# EasyEDA Pro project DartBLDC_Crtl(V2).eprj

# Schematic DartBLDC_Crtl

## Sheets
1 MainBoard: Create Date: 2024-02-13; Page Name: MainBoard; Project Name: DartBLDC_Crtl(V2); Schematic Name: DartBLDC_Crtl; Update Date: 2024-03-26; Company: SEU; Drawed: 陈申; Page Size: A3; Version: V1.0
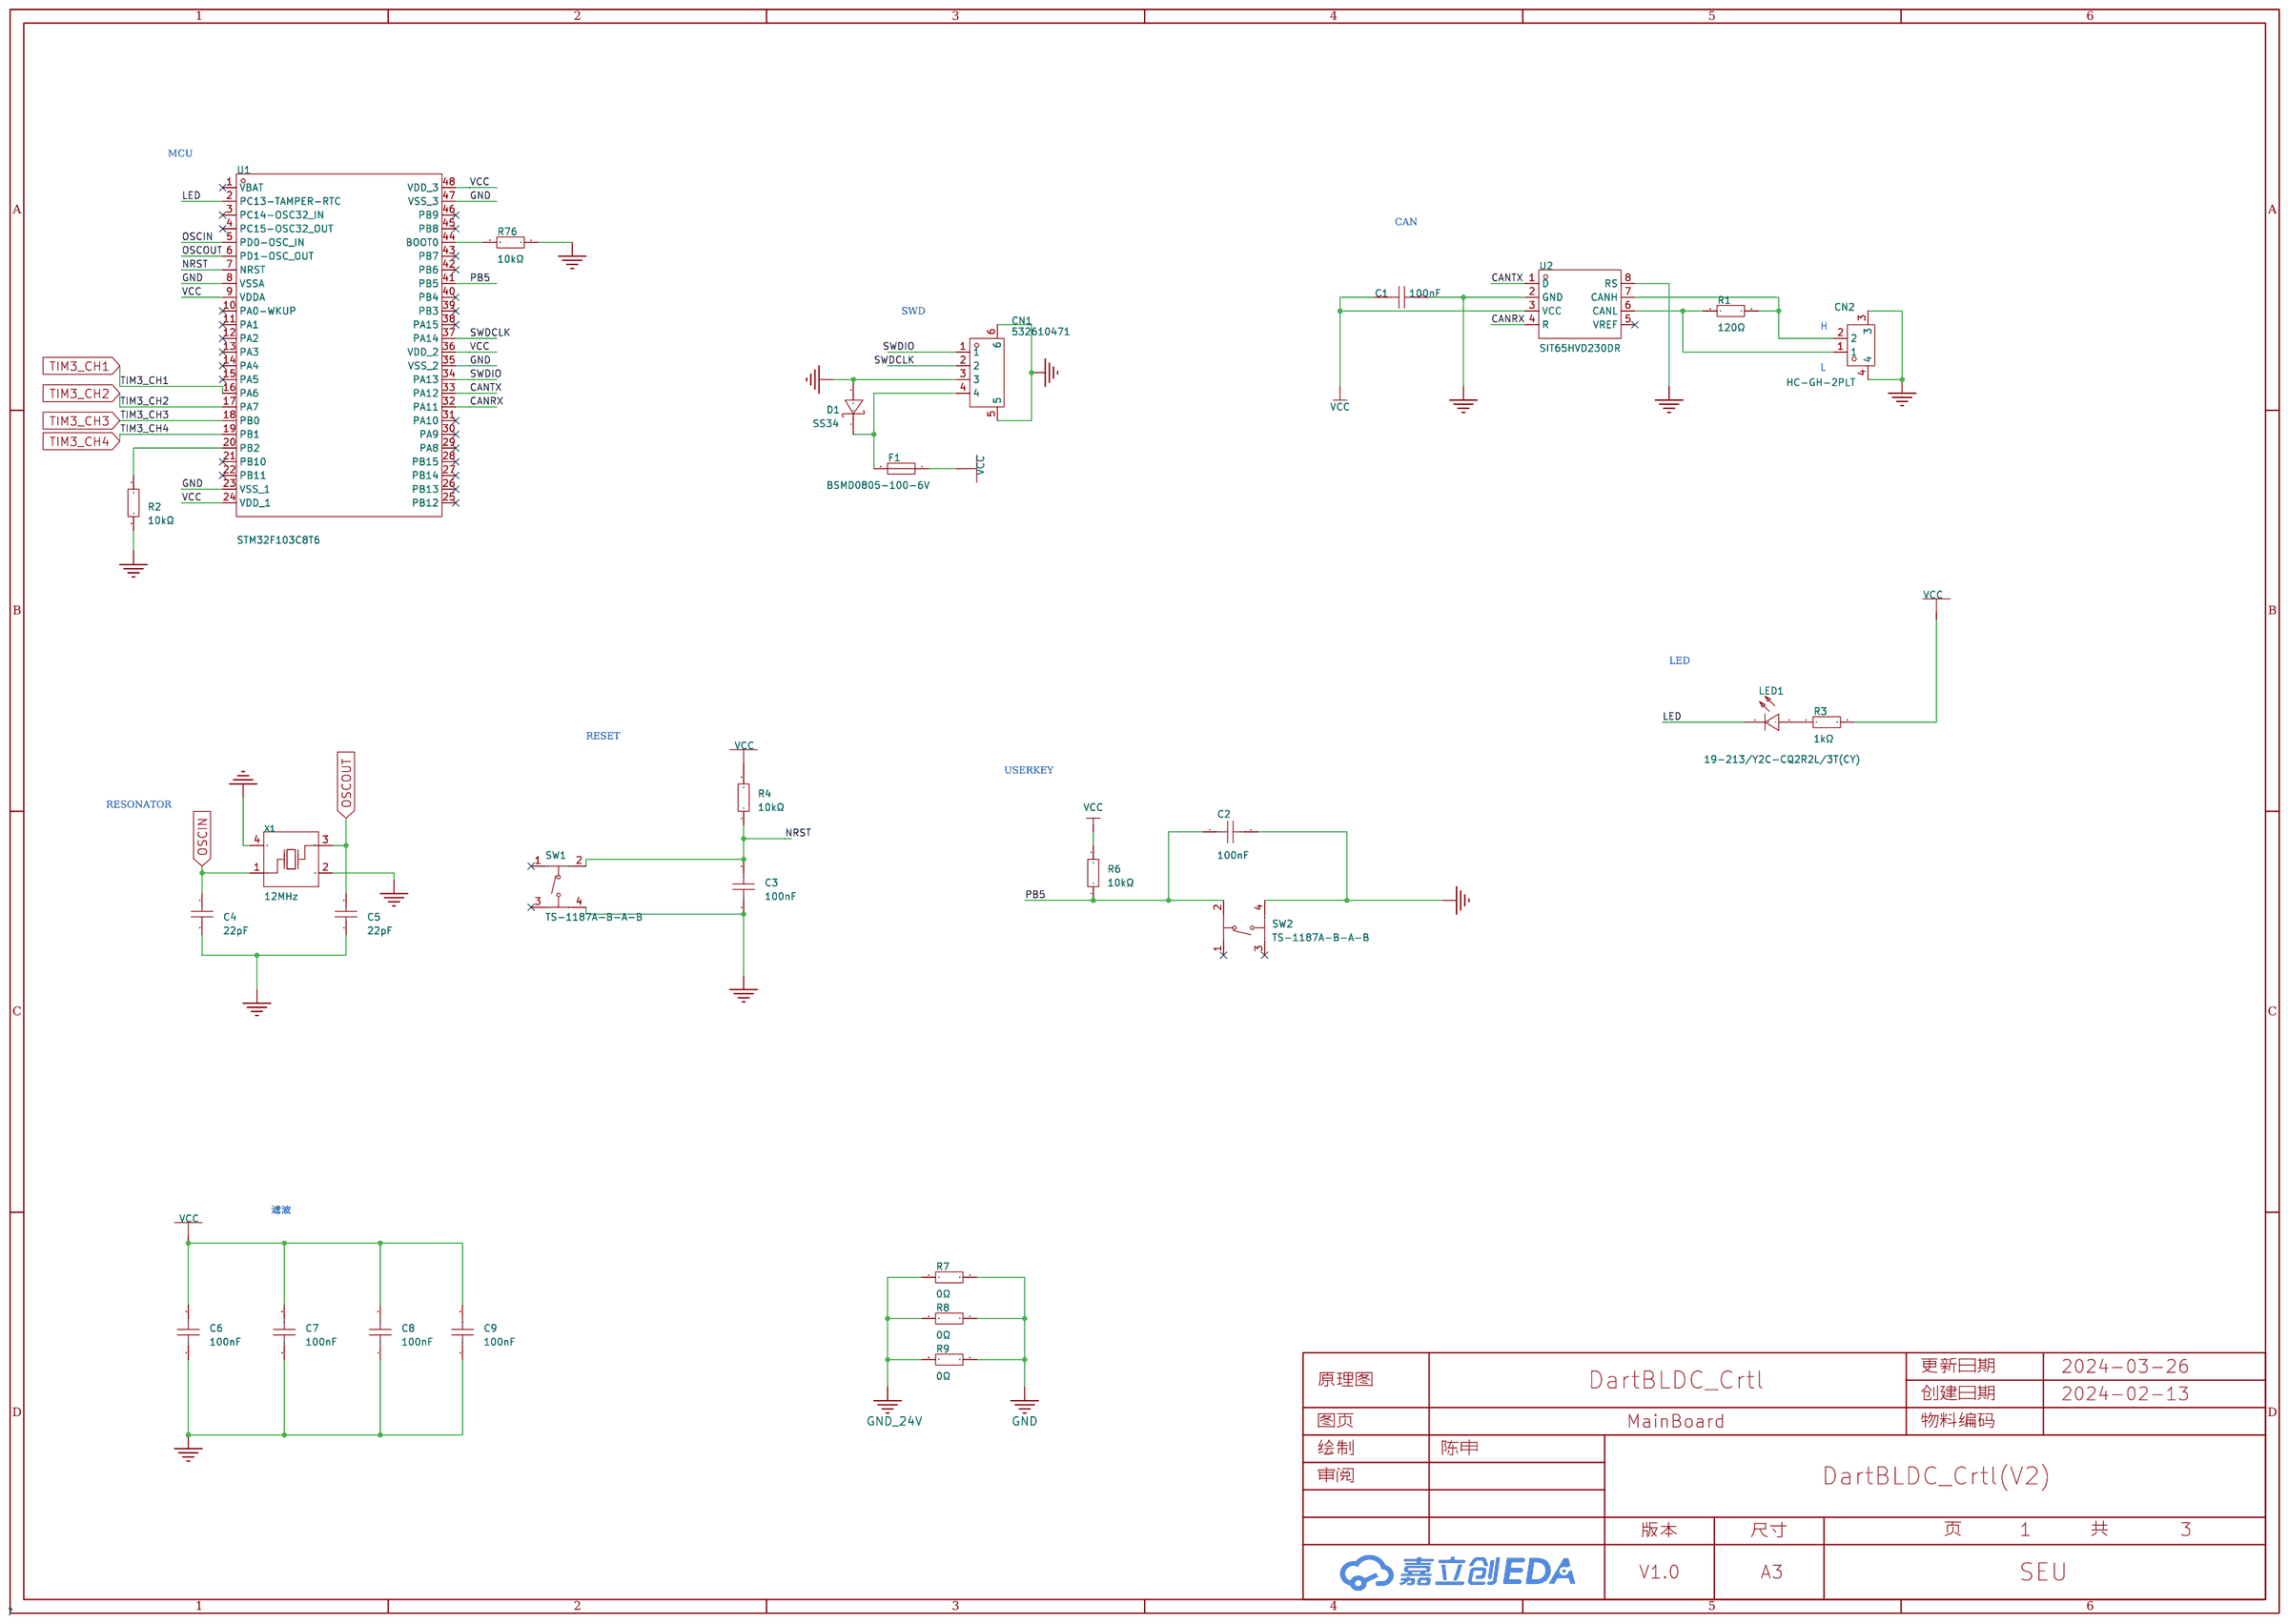
[diagram p0: MainBoard]
2 SpeedTest: Create Date: 2024-03-25; Page Name: SpeedTest; Company: 嘉立创EDA; Page Size: A4
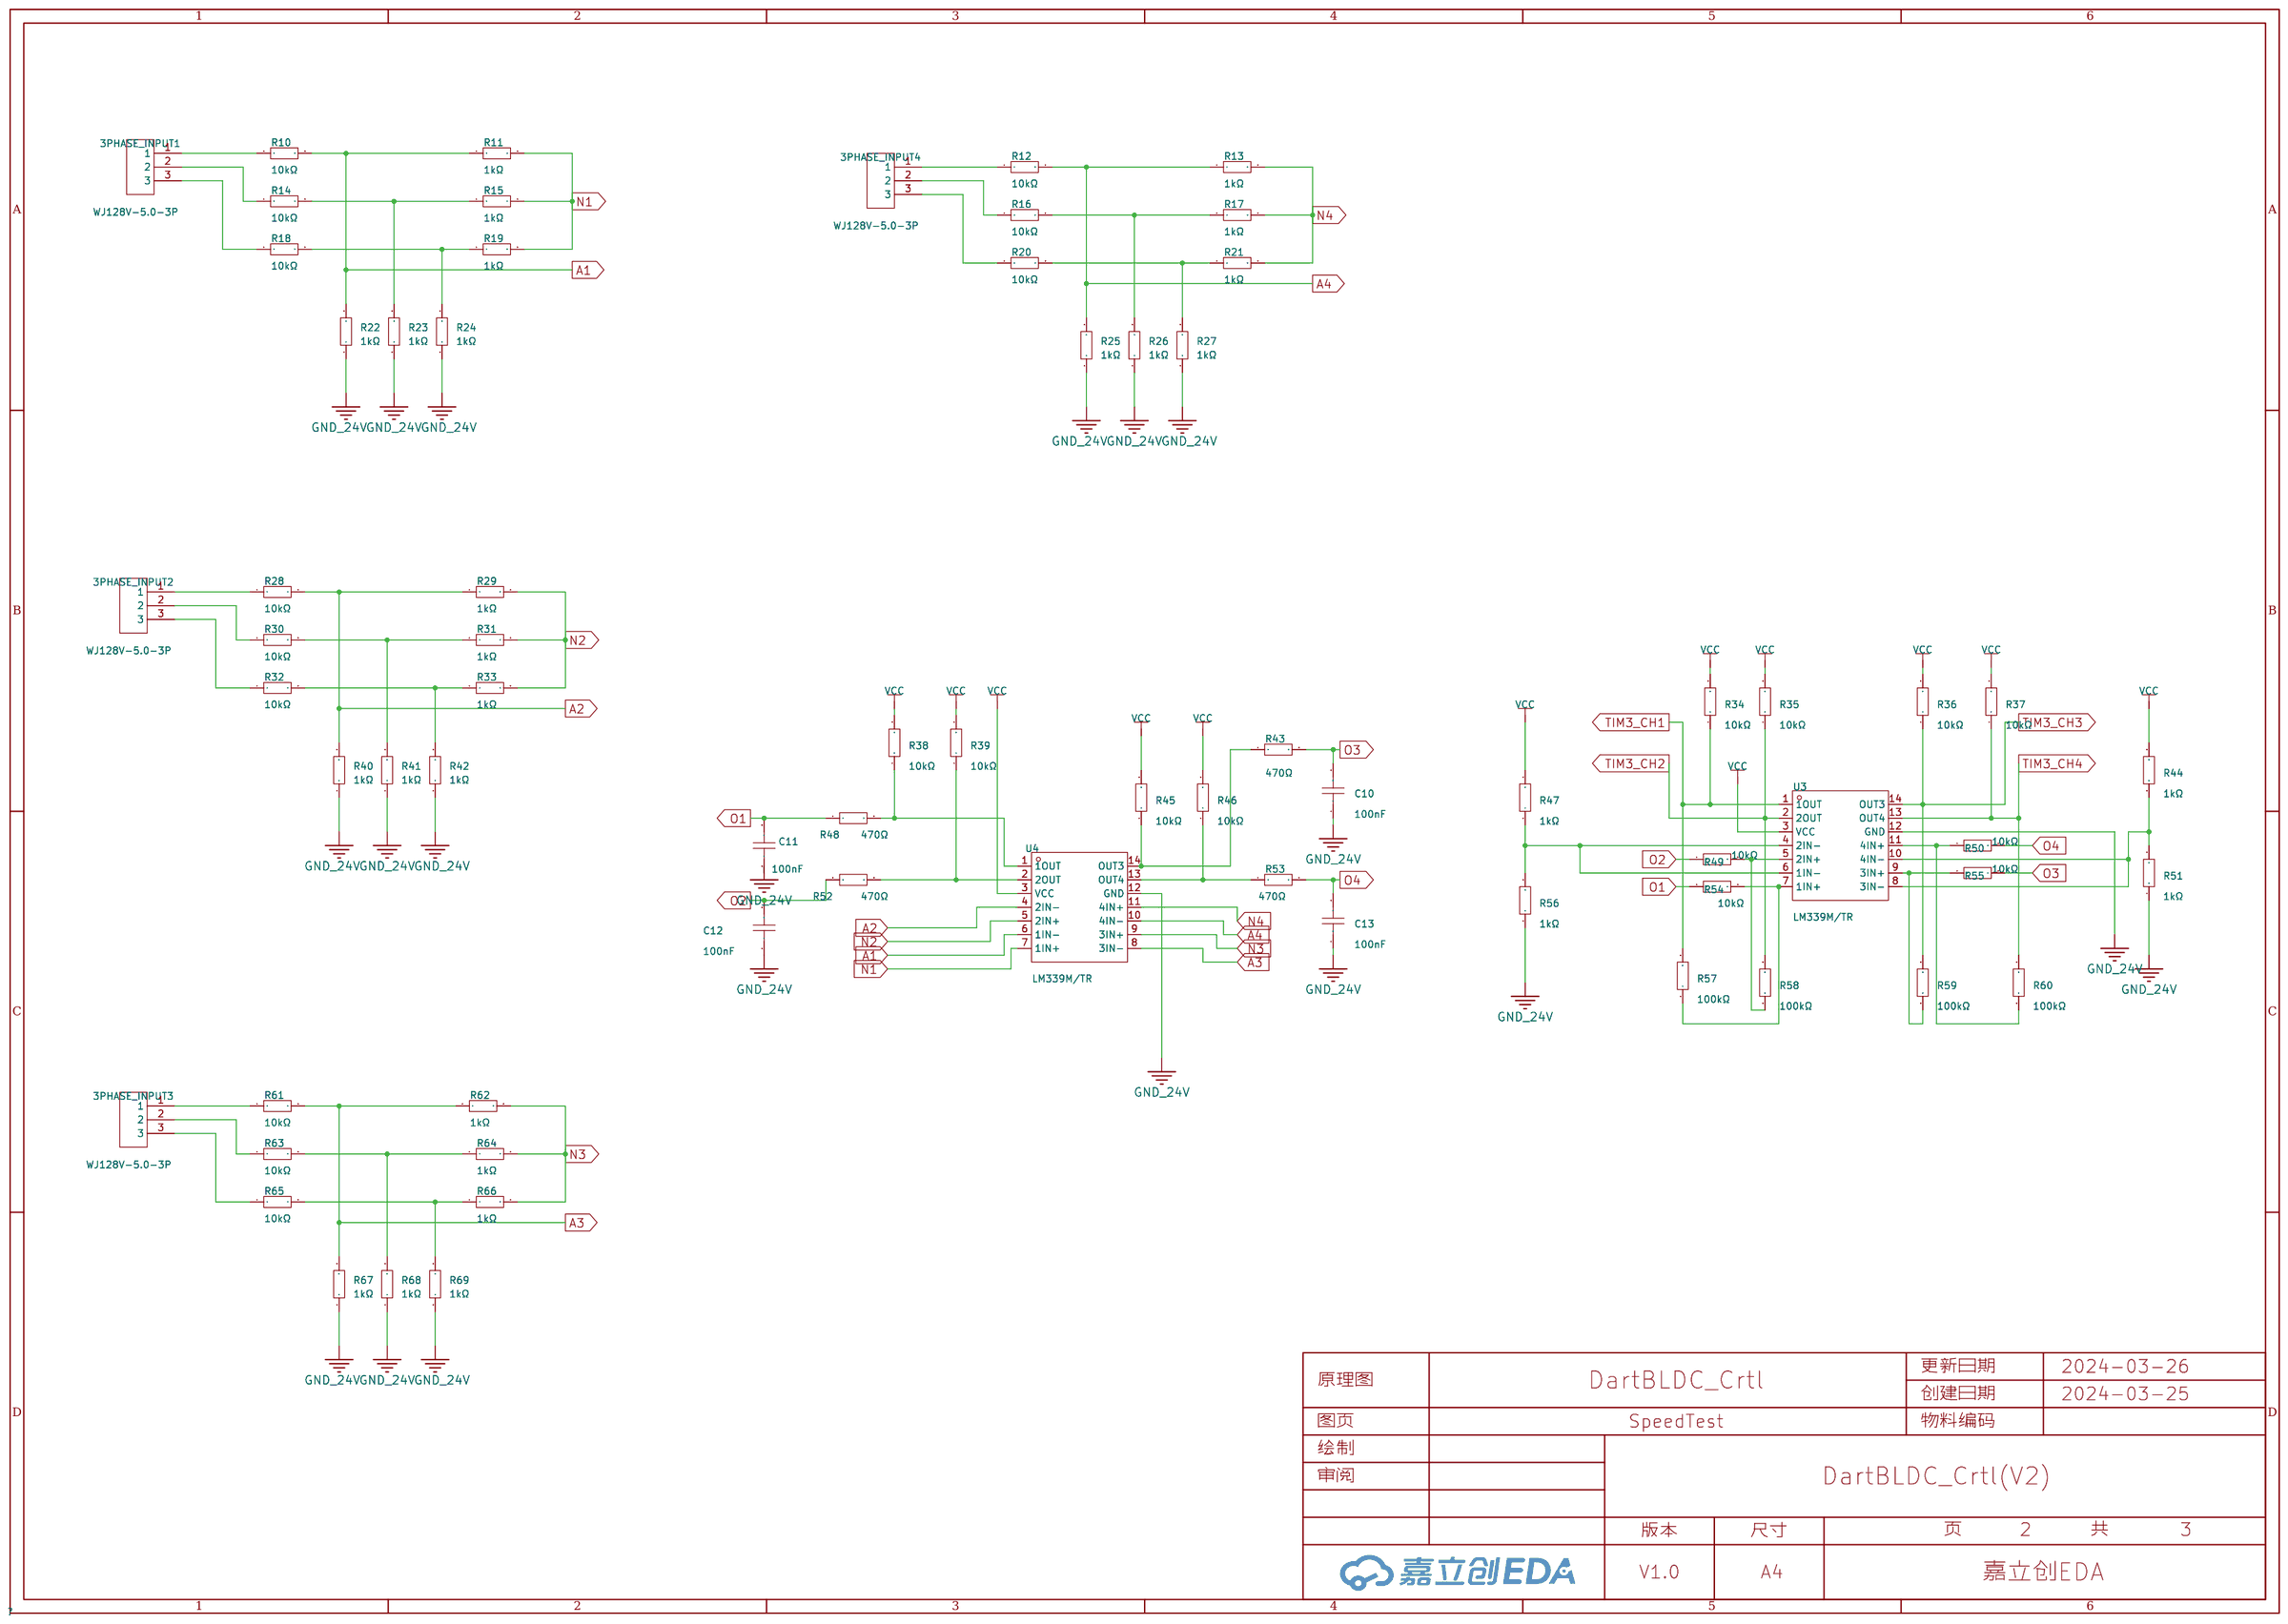
[diagram p1: SpeedTest]
3 PowerSupply: Create Date: 2024-03-25; Page Name: PowerSupply; Company: 嘉立创EDA; Page Size: A4
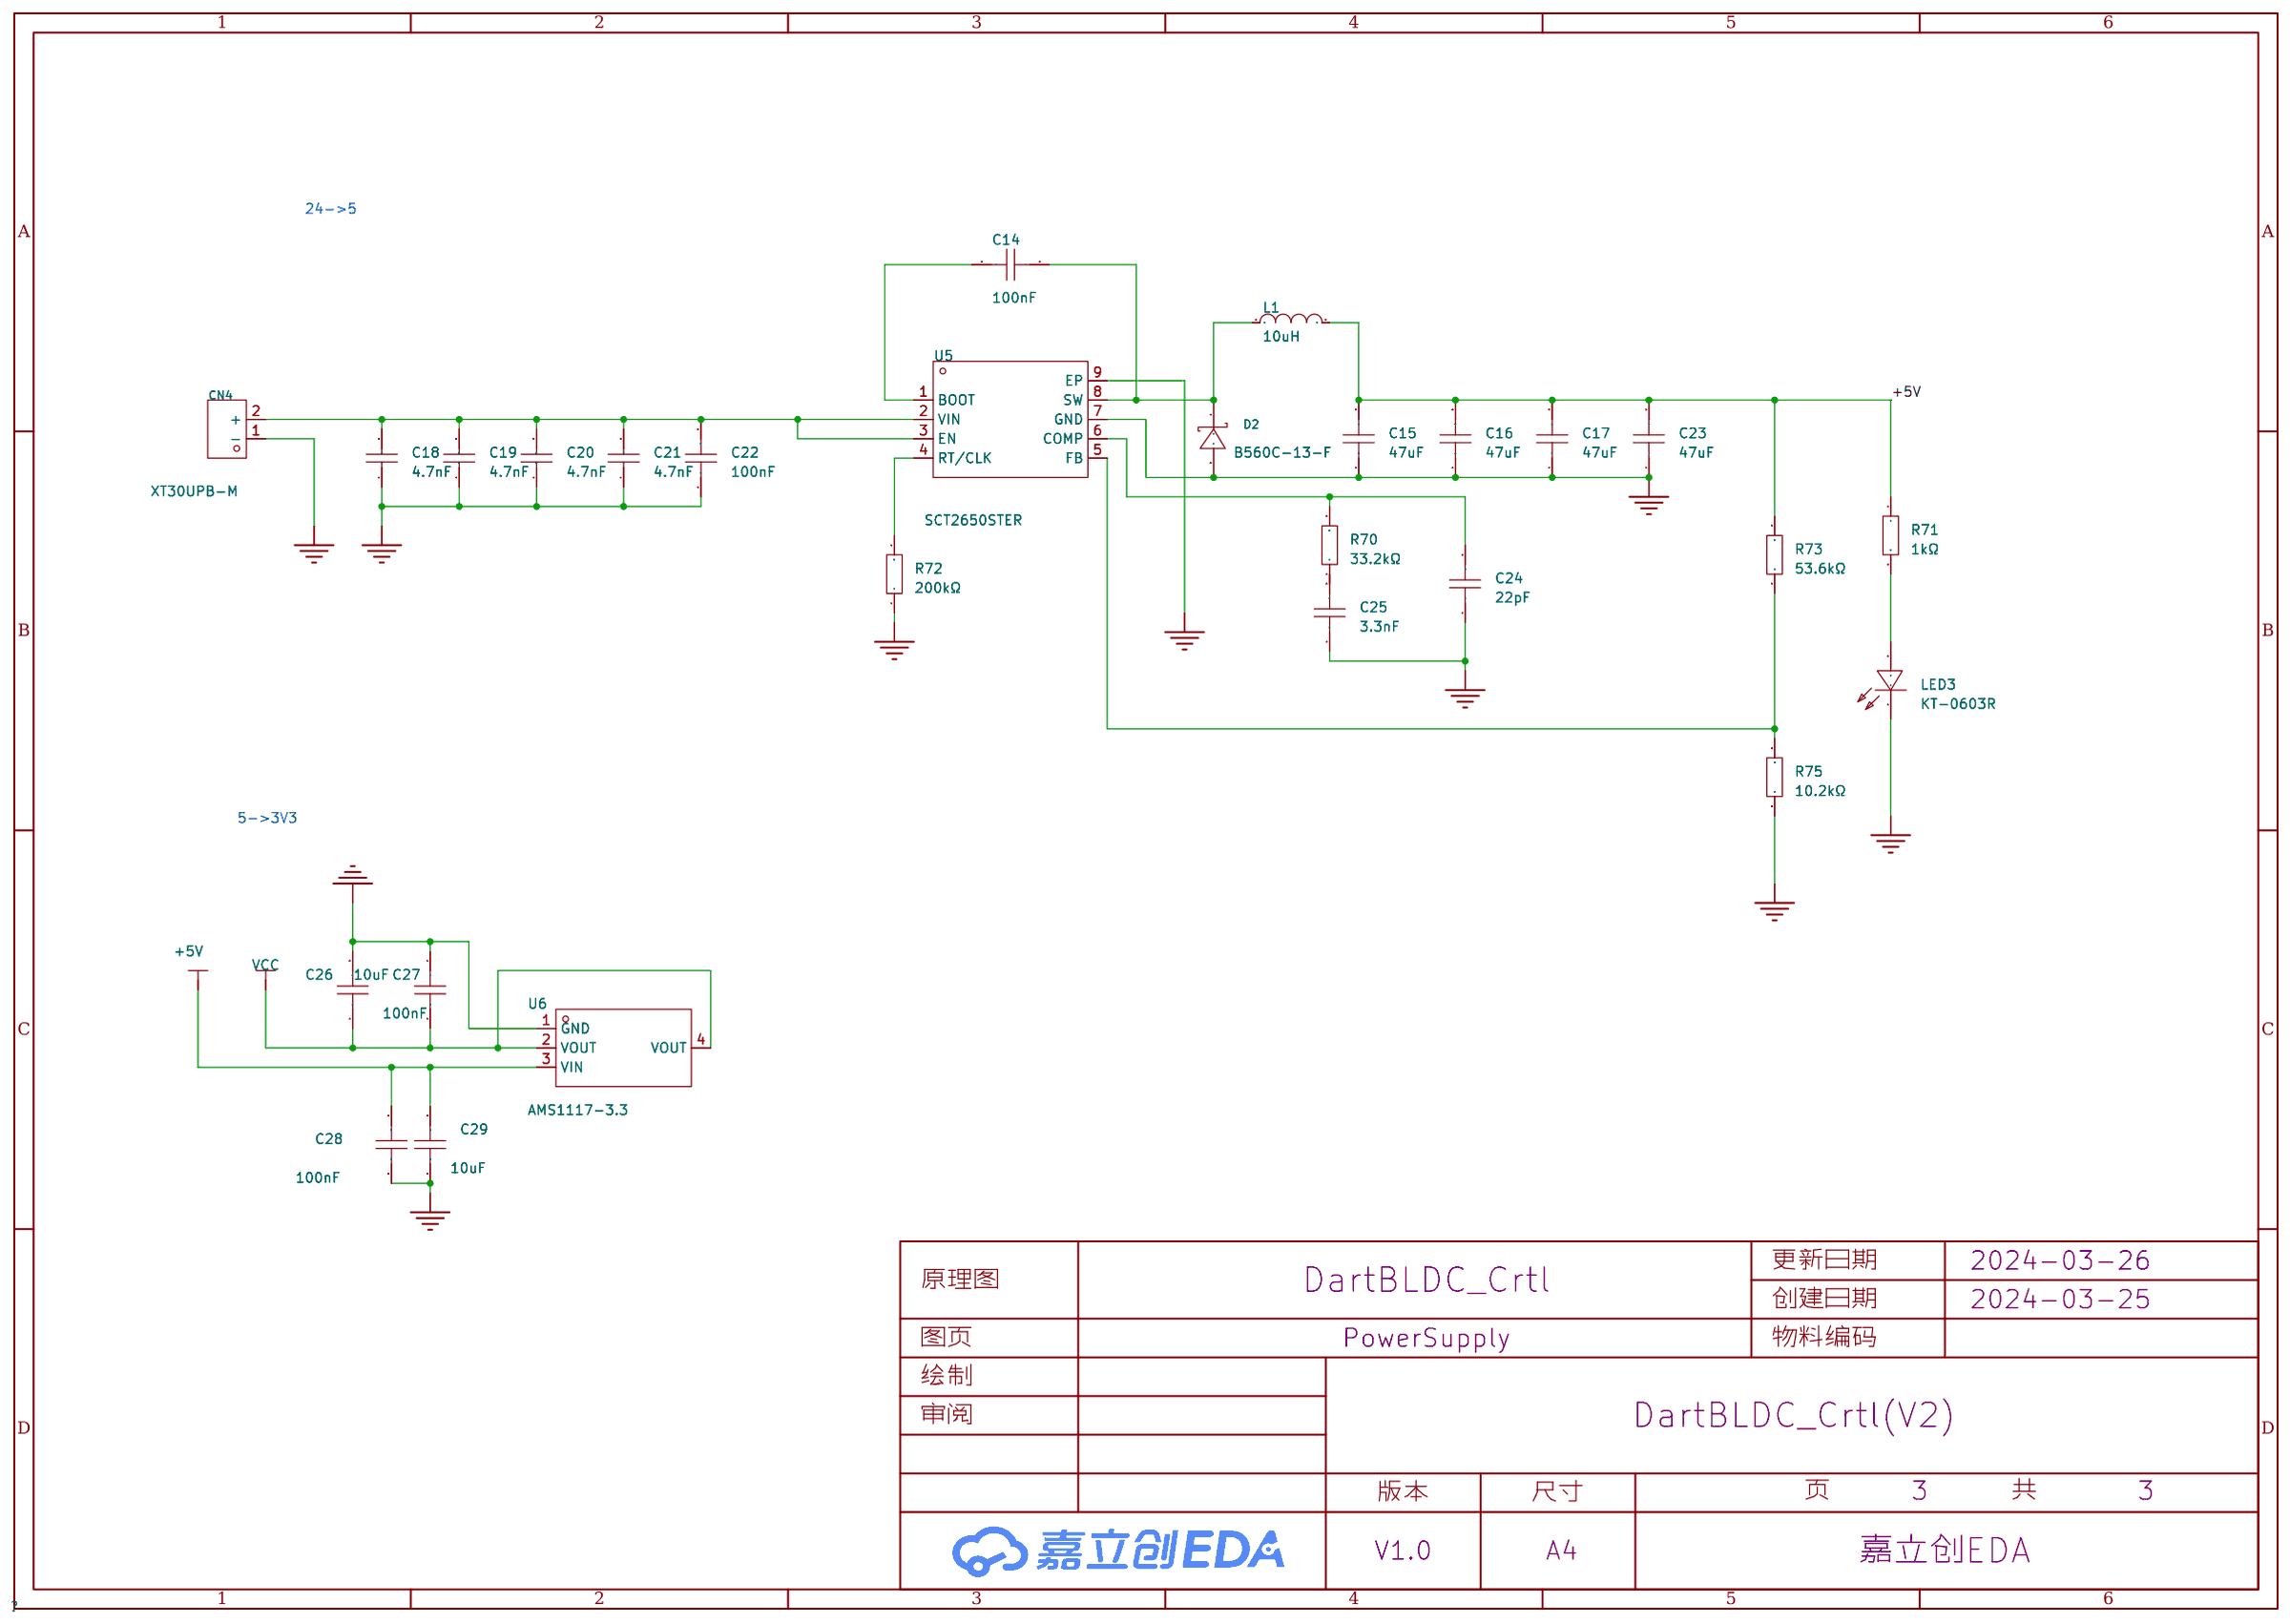
[diagram p2: PowerSupply]

## Parts
sheet MainBoard
C1  100nF  [C0603]
C2  100nF  [C0603]
C3  100nF  [C0603]
C4  22pF  [C0603]
C5  22pF  [C0603]
C6  100nF  [C0603]
C7  100nF  [C0603]
C8  100nF  [C0603]
C9  100nF  [C0603]
CN1  532610471  [CONN-SMD_4P-P1.25_53261-0471]
CN2  HC-GH-2PLT  [CONN-SMD_2P-P1.25_HCTL_HC-GH-2PLT]
D1  SS34  [SMA_L4.3-W2.6-LS5.2-RD]
F1  BSMD0805-100-6V  [F0805]
LED1  19-213/Y2C-CQ2R2L/3T(CY)  [LED0603-RD-YELLOW]
R1  120Ω  [R0603]
R2  10kΩ  [R0603]
R3  1kΩ  [R0603]
R4  10kΩ  [R0603]
R6  10kΩ  [R0603]
R7  0Ω  [R0603]
R8  0Ω  [R0603]
R9  0Ω  [R0603]
R76  10kΩ  [R0603]
SW1  TS-1187A-B-A-B  [SW-SMD_4P-L5.1-W5.1-P3.70-LS6.5-TL-2]
SW2  TS-1187A-B-A-B  [SW-SMD_4P-L5.1-W5.1-P3.70-LS6.5-TL-2]
U1  STM32F103C8T6  [LQFP-48_L7.0-W7.0-P0.50-LS9.0-BL]
U2  SIT65HVD230DR  [SOP-8_L4.9-W3.9-P1.27-LS6.0-BL]
X1  12MHz  [OSC-SMD_4P-L3.2-W2.5-BL]
sheet PowerSupply
C14  100nF  [C0603]
C15  47uF  [C1206]
C16  47uF  [C1206]
C17  47uF  [C1206]
C18  4.7nF  [C0603]
C19  4.7nF  [C0603]
C20  4.7nF  [C0603]
C21  4.7nF  [C0603]
C22  100nF  [C0603]
C23  47uF  [C1206]
C24  22pF  [C0603]
C25  3.3nF  [C0603]
C26  10uF  [C0603]
C27  100nF  [C0603]
C28  100nF  [C0603]
C29  10uF  [C0603]
CN4  XT30UPB-M  [CONN-TH_XT30UPB-M]
D2  B560C-13-F  [SMC_L7.1-W6.2-LS8.1-RD]
L1  10uH  [IND-SMD_L5.4-W5.2]
LED3  KT-0603R  [LED0603-RD]
R70  33.2kΩ  [R0603]
R71  1kΩ  [R0603]
R72  200kΩ  [R0603]
R73  53.6kΩ  [R0603]
R75  10.2kΩ  [R0603]
U5  SCT2650STER  [ESOP-8_L4.9-W3.9-P1.27-LS6.0-BL-EP-2]
U6  AMS1117-3.3  [SOT-223-3_L6.5-W3.4-P2.30-LS7.0-BR]
sheet SpeedTest
3PHASE_INPUT1  WJ128V-5.0-3P  [CONN-TH_3P-P5.00_WJ128V-5.0-3P]
3PHASE_INPUT2  WJ128V-5.0-3P  [CONN-TH_3P-P5.00_WJ128V-5.0-3P]
3PHASE_INPUT3  WJ128V-5.0-3P  [CONN-TH_3P-P5.00_WJ128V-5.0-3P]
3PHASE_INPUT4  WJ128V-5.0-3P  [CONN-TH_3P-P5.00_WJ128V-5.0-3P]
C10  100nF  [C0603]
C11  100nF  [C0603]
C12  100nF  [C0603]
C13  100nF  [C0603]
R10  10kΩ  [R0603]
R11  1kΩ  [R0603]
R12  10kΩ  [R0603]
R13  1kΩ  [R0603]
R14  10kΩ  [R0603]
R15  1kΩ  [R0603]
R16  10kΩ  [R0603]
R17  1kΩ  [R0603]
R18  10kΩ  [R0603]
R19  1kΩ  [R0603]
R20  10kΩ  [R0603]
R21  1kΩ  [R0603]
R22  1kΩ  [R0603]
R23  1kΩ  [R0603]
R24  1kΩ  [R0603]
R25  1kΩ  [R0603]
R26  1kΩ  [R0603]
R27  1kΩ  [R0603]
R28  10kΩ  [R0603]
R29  1kΩ  [R0603]
R30  10kΩ  [R0603]
R31  1kΩ  [R0603]
R32  10kΩ  [R0603]
R33  1kΩ  [R0603]
R34  10kΩ  [R0603]
R35  10kΩ  [R0603]
R36  10kΩ  [R0603]
R37  10kΩ  [R0603]
R38  10kΩ  [R0603]
R39  10kΩ  [R0603]
R40  1kΩ  [R0603]
R41  1kΩ  [R0603]
R42  1kΩ  [R0603]
R43  470Ω  [R0603]
R44  1kΩ  [R0603]
R45  10kΩ  [R0603]
R46  10kΩ  [R0603]
R47  1kΩ  [R0603]
R48  470Ω  [R0603]
R49  10kΩ  [R0603]
R50  10kΩ  [R0603]
R51  1kΩ  [R0603]
R52  470Ω  [R0603]
R53  470Ω  [R0603]
R54  10kΩ  [R0603]
R55  10kΩ  [R0603]
R56  1kΩ  [R0603]
R57  100kΩ  [R0603]
R58  100kΩ  [R0603]
R59  100kΩ  [R0603]
R60  100kΩ  [R0603]
R61  10kΩ  [R0603]
R62  1kΩ  [R0603]
R63  10kΩ  [R0603]
R64  1kΩ  [R0603]
R65  10kΩ  [R0603]
R66  1kΩ  [R0603]
R67  1kΩ  [R0603]
R68  1kΩ  [R0603]
R69  1kΩ  [R0603]
U3  LM339M/TR  [SOP-14_L8.6-W3.9-P1.27-LS6.0-BL]
U4  LM339M/TR  [SOP-14_L8.6-W3.9-P1.27-LS6.0-BL]
